# EasyEDA Pro project BLDCv5.eprj, schematic Schematic2
Create Date: 2024-10-30; Page Name: P1; Project Name: BLDCv5; Schematic Name: Schematic2; Update Date: 2024-11-02; Company: EasyEDA.com; Drawn: EasyEDA; Page Size: A4; Part Number: JLCPCB-002; Reviewed: EasyEDA; Version: V0.1
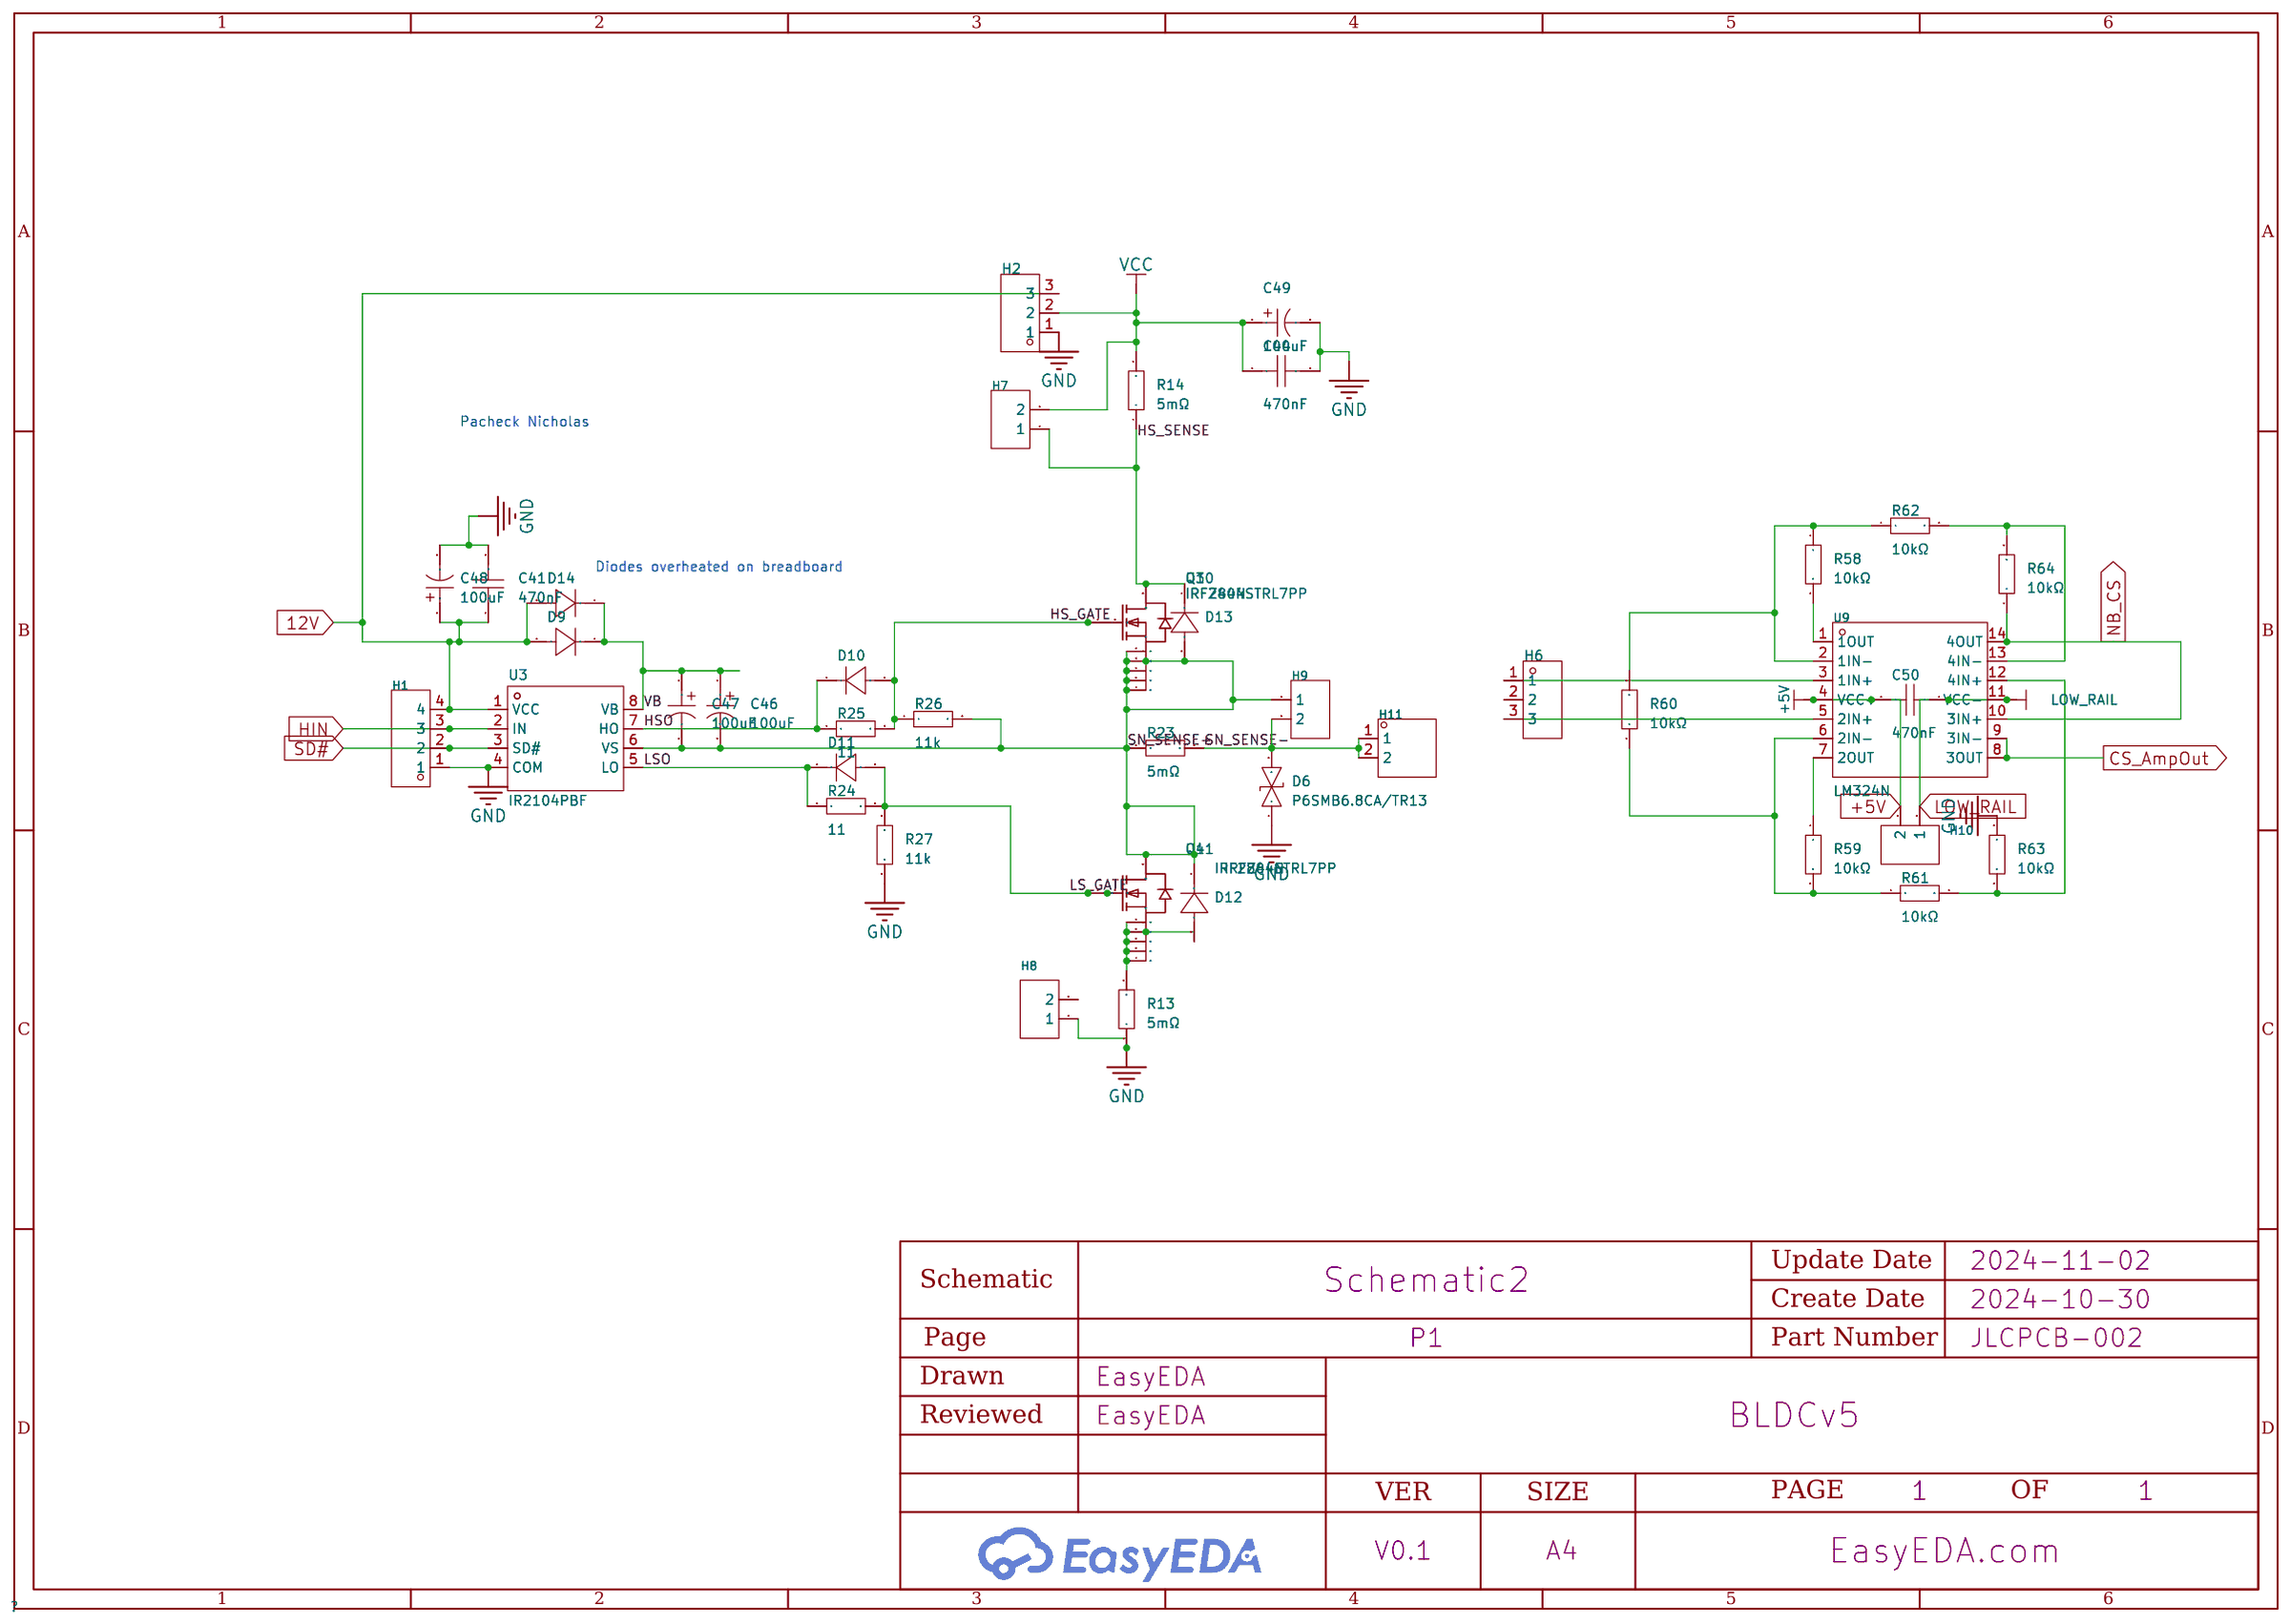
[diagram p2: schematic sheet]

## Parts
C41  470nF  [CAP-TH_L7.2-W2.5-P5.00-D0.5]
C44  470nF  [CAP-TH_L7.2-W2.5-P5.00-D0.5]
C46  100uF  [CAP-TH_BD8.0-P3.50-D0.6-FD]
C47  100uF  [CAP-TH_BD8.0-P3.50-D0.6-FD]
C48  100uF  [CAP-TH_BD8.0-P3.50-D0.6-FD]
C49  100uF  [CAP-TH_BD8.0-P3.50-D0.6-FD]
C50  470nF  [CAP-TH_L7.2-W2.5-P5.00-D0.5]
D6  P6SMB6.8CA/TR13  [SMB_L4.6-W3.6-LS5.3-BI]
D9  -  [DO-41_BD2.4-L4.7-P8.70-D0.9-RD]
D10  -  [DO-41_BD2.4-L4.7-P8.70-D0.9-RD]
D11  -  [DO-41_BD2.4-L4.7-P8.70-D0.9-RD]
D12  -  [DO-41_BD2.4-L4.7-P8.70-D0.9-RD]
D13  -  [DO-41_BD2.4-L4.7-P8.70-D0.9-RD]
D14  -  [DO-41_BD2.4-L4.7-P8.70-D0.9-RD]
H1  -  [HDR-TH_4P-P2.54-V-F]
H2  -  [HDR-TH_3P-P2.54-V-F]
H6  -  [HDR-TH_3P-P2.54-V-M]
H7  -  [HDR-TH_2P-P2.54-V-F]
H8  -  [HDR-TH_2P-P2.54-V-F]
H9  -  [HDR-TH_2P-P2.54-V-F]
H10  -  [HDR-TH_2P-P2.54-V-F]
H11  -  [HDR-TH_2P-P2.54-V-M-1]
Q3  IRF2804STRL7PP  [D2PAK-7_L10.6-W9.6-P1.27-LS15.9-BR]
Q4  IRF2804STRL7PP  [D2PAK-7_L10.6-W9.6-P1.27-LS15.9-BR]
R13  5mΩ  [R2512]
R14  5mΩ  [R2512]
R23  5mΩ  [R2512]
R24  11  [RES-TH_BD3.3-L9.0-P13.00-D0.6]
R25  11  [RES-TH_BD3.3-L9.0-P13.00-D0.6]
R26  11k  [RES-TH_BD3.3-L9.0-P13.00-D0.6]
R27  11k  [RES-TH_BD3.3-L9.0-P13.00-D0.6]
R58  10kΩ  [R_AXIAL-0.4]
R59  10kΩ  [R_AXIAL-0.4]
R60  10kΩ  [R_AXIAL-0.4]
R61  10kΩ  [R_AXIAL-0.4]
R62  10kΩ  [R_AXIAL-0.4]
R63  10kΩ  [R_AXIAL-0.4]
R64  10kΩ  [R_AXIAL-0.4]
U3  IR2104PBF  [DIP-8_L9.9-W6.6-P2.54-LS7.62-BL]
U9  LM324N  [DIP-14_L19.3-W7.0-P2.54-LS7.6-BL]
U10  IRFZ44N  [TO-220-3_L9.9-W4.5-P2.54-L]
U11  IRFZ44N  [TO-220-3_L9.9-W4.5-P2.54-L]

## Library data of the parts
C41 C44 C50 = C241J474J20C000: Capacitance:470nF Tolerance:±5% Tolerance:±5% Voltage Rated: Dielectric Material:Metallized Polyester Film Capacitor Operating Temperature:-55℃~+125℃ Operating Temperature:-55℃~+125℃; LCSC Part Name: 470nF ±5% 63V; Supplier Part: C5121927; Manufacturer: faratronic(厦门法拉); Supplier Footprint: 插件,P=5mm; JLCPCB Part Class: Extended Part; Datasheet: https://atta.szlcsc.com/upload/public/pdf/source/20220309/53E9D6585E584592026F1B9FCED89B93.pdf; Supplier: LCSC; Tolerance: ±5%; Dielectric Material: Metallized Polyester Film Capacitor; Operating Temperature: -55℃~+125℃
C46-C49 = EGT226M2AF12RR: Capacitance: Tolerance:±20% Tolerance:±20% Rated Voltage: Ripple Current:- Equivalent Series Resistance(ESR):- Lead Spacing: φD:- L:- Lifetime @ Temp:7000hrs@105℃ Operating Temperature:-45℃~+105℃ Operating Temperature:-45℃~+105℃; LCSC Part Name: 22uF ±20% 100V; Supplier Part: C840214; Manufacturer: MAN YUE(万裕科技); Supplier Footprint: 插件; JLCPCB Part Class: Extended Part; Datasheet: https://atta.szlcsc.com/upload/public/pdf/source/20181204/C235371_127DC39C6F805AD99E748A9DC446523D.pdf; Supplier: LCSC; Tolerance: ±20%; Lifetime @ Temp: 7000hrs@105℃; Operating Temperature: -45℃~+105℃
D6 = P6SMB6.8CA/TR13: Reverse Stand-Off Voltage (Vrwm):5.8V Maximum Clamping Voltage:10.5V Peak Pulse Current (Ipp)@10/1000us:58.1A Peak Pulse Power Dissipation (Ppp)@10/1000us:600W Breakdown Voltage:6.45V Type:TVS; Supplier Part: C78395; Manufacturer: Brightking(君耀电子); Supplier Footprint: SMB(DO-214AA); JLCPCB Part Class: Basic Part; Datasheet: https://atta.szlcsc.com/upload/public/pdf/source/20160709/1468031879762.pdf; Supplier: LCSC; Reverse Stand-Off Voltage (Vrwm): 5.8V; Maximum Clamping Voltage: 10.5V; Peak Pulse Current (Ipp)@10/1000us: 58.1A; Peak Pulse Power Dissipation (Ppp)@10/1000us: 600W; Breakdown Voltage: 6.45V; Type: TVS
D9-D14 = 1N4007: Supplier Footprint: DO-41
H1 = HDR-F_2.54_1x4P: Supplier Footprint: Through
H2 = HDR-F_2.54_1x3P: Supplier Footprint: Through
H6 = HDR-M_2.54_1x3P: Supplier Footprint: Through
H7-H10 = HDR-F_2.54_1x2P: Supplier Footprint: Through
H11 = HDR-M_2.54_1x2P: Supplier Footprint: Through
Q3 Q4 = IRF2804STRL7PP: Supplier Part: C459950; Manufacturer: Infineon(英飞凌); Supplier Footprint: TO-252-3; JLCPCB Part Class: Extended Part; Datasheet: https://atta.szlcsc.com/upload/public/pdf/source/20211220/39CD65D483719D465F1A88FFAD2C5DF5.pdf; Supplier: LCSC
R13 R14 R23 = PA2512FKF7W0R005E: Type:Current Sensing Resistors Resistance: Tolerance:±1% Tolerance:±1% Power(Watts): Temperature Coefficient:±100ppm/℃ Temperature Coefficient:±100ppm/℃; LCSC Part Name: 5mΩ ±1% 2W; Supplier Part: C309526; Manufacturer: YAGEO(国巨); Supplier Footprint: 2512; JLCPCB Part Class: Extended Part; Datasheet: https://atta.szlcsc.com/upload/public/pdf/source/20190227/C375693_219964CC8B3EBD36DBDF701587FA5938.pdf; Supplier: LCSC; Type: Current Sensing Resistors; Tolerance: ±1%; Temperature Coefficient: ±100ppm/℃
R24-R27 = Res_AXIAL-1/2W: Supplier Footprint: Through
R58-R64 = Res_AXIAL-1/4W: Supplier Footprint: Through
U3 = IR2104PBF: Driven Configuration:Half Bridge Load Type:MOSFET；IGBT Number of Drivers:2 Peak Output Current(sink):360mA Peak Output Current(source):210mA Supply Voltage:10V~20V Supply Voltage:10V~20V Rise Time:100ns Fall Time:50ns Operating Temperature:-40℃~+150℃@(Tj); LCSC Part Name: IR2104PBF 停产; Supplier Part: C2959; Manufacturer: Infineon(英飞凌); Supplier Footprint: PDIP-8; JLCPCB Part Class: Extended Part; Datasheet: https://atta.szlcsc.com/upload/public/pdf/source/20140906/1457707236579.pdf; Supplier: LCSC; Driven Configuration: Half Bridge; Load Type: MOSFET；IGBT; Number of Drivers: 2; Peak Output Current(sink): 360mA; Peak Output Current(source): 210mA; Supply Voltage: 10V~20V; Rise Time: 100ns; Fall Time: 50ns; Operating Temperature: -40℃~+150℃@(Tj)
U9 = LM324N_C114380: Number of Circuits:Quad Gain Bandwidth Product(GBP):1.2MHz Current - Input Bias(Ib):45nA Slew Rate(SR):- Output Current:40mA -3db Bandwidth:- Supply Current:1mA Operating Temperature:0℃~+70℃ Operating Temperature:0℃~+70℃; Supplier Part: C114380; Manufacturer: TI(德州仪器); Supplier Footprint: DIP-14; JLCPCB Part Class: Extended Part; Datasheet: https://www.ti.com/cn/lit/gpn/lm324; Supplier: LCSC; Number of Circuits: Quad; Gain Bandwidth Product(GBP): 1.2MHz; Current - Input Bias(Ib): 45nA; Output Current: 40mA; Supply Current: 1mA; Operating Temperature: 0℃~+70℃
U10 U11 = IRFZ44N: Type:1个NChannel Drain Source Voltage (Vdss):60V Continuous Drain Current (Id): Power Dissipation (Pd): Drain Source On Resistance (RDS(on)@Vgs,Id):12mΩ@10V,25A Gate Threshold Voltage (Vgs(th)@Id):3V@250uA Total Gate Charge (Qg@Vgs):31nC@10V Input Capacita; LCSC Part Name: 1个N沟道 耐压:60V 电流:60A; Supplier Part: C7429904; Manufacturer: minos(迈诺斯); Supplier Footprint: TO-220; JLCPCB Part Class: Extended Part; Datasheet: https://atta.szlcsc.com/upload/public/pdf/source/20230807/91A846AFF378822B6B73E3D1D52219D8.pdf; Supplier: LCSC; Type: 1个NChannel; Drain Source Voltage (Vdss): 60V; Drain Source On Resistance (RDS(on)@Vgs,Id): 12mΩ@10V,25A; Gate Threshold Voltage (Vgs(th)@Id): 3V@250uA; Total Gate Charge (Qg@Vgs): 31nC@10V; Input Capacitance (Ciss@Vds): 910pF@25V; Reverse Transfer Capacitance (Crss@Vds): 30pF@25V; Operating Temperature: -55℃~+175℃@(Tj)

## Nets
12V: C41.1 C48.1 D9.2(A) D14.2(A) H1.4 H2.3 U3.1(VCC)
+5V: C50.2 H10.2 U9.4(VCC+)
GND: C41.2 C44.2 C48.2 C49.2 D6.1 H1.1 H2.1 H8.1 R13.1 R27.1 R63.2 U3.4(COM)
VCC: C44.1 C49.1 H2.2 H7.2 R14.2
CS_AmpOut: U9.8(3OUT) U9.9(3IN-)
HIN: H1.3 U3.2(IN)
HS_GATE: D10.2(A) Q3.1(G) R25.2 R26.1 U10.1(G)
HS_SENSE: D13.1(K) H7.1 Q3.4(D) R14.1 U10.2(D)
HSO: D10.1(K) R25.1 U3.7(HO)
LOW_RAIL: C50.1 H10.1 U9.11(VCC-)
LS_GATE: D11.2(A) Q4.1(G) R24.2 R27.2 U11.1(G)
LSO: D11.1(K) R24.1 U3.5(LO)
NB_CS: R64.1 U9.10(3IN+) U9.14(4OUT)
SD#: H1.2 U3.3(SD#)
SN_SENSE+: C46.2 C47.2 D12.1(K) D13.2(A) H9.1 Q3.2(S) Q3.3(S) Q3.5(S) Q3.6(S) Q3.7(S) Q4.4(D) R23.2 R26.2 U3.6(VS) U10.3(S) U11.2(D)
SN_SENSE-: D6.2 H9.2 H11.1 H11.2 R23.1
VB: C46.1 C47.1 D9.1(K) D14.1(K) U3.8(VB)
$1N1517: R58.2 U9.1(1OUT)
$1N1518: R59.1 U9.7(2OUT)
$1N1519: R59.2 R60.1 R61.1 U9.6(2IN-)
$1N1520: R58.1 R60.2 R62.1 U9.2(1IN-)
$1N1523: R61.2 R63.1 U9.12(4IN+)
$1N1525: R62.2 R64.2 U9.13(4IN-)
$1N1721: H6.1 U9.3(1IN+)
$1N1748: H6.3 U9.5(2IN+)
$1N4504: D12.2(A) Q4.2(S) Q4.3(S) Q4.5(S) Q4.6(S) Q4.7(S) R13.2 U11.3(S)

Not connected (* = marked no-connect by the designer): H6 2; H8 2

## Notes on the sheet
- Pacheck Nicholas
- Diodes overheated on breadboard
